# EasyEDA Pro project kuafu01_030内部老化方案_4.eprj, board PCB4
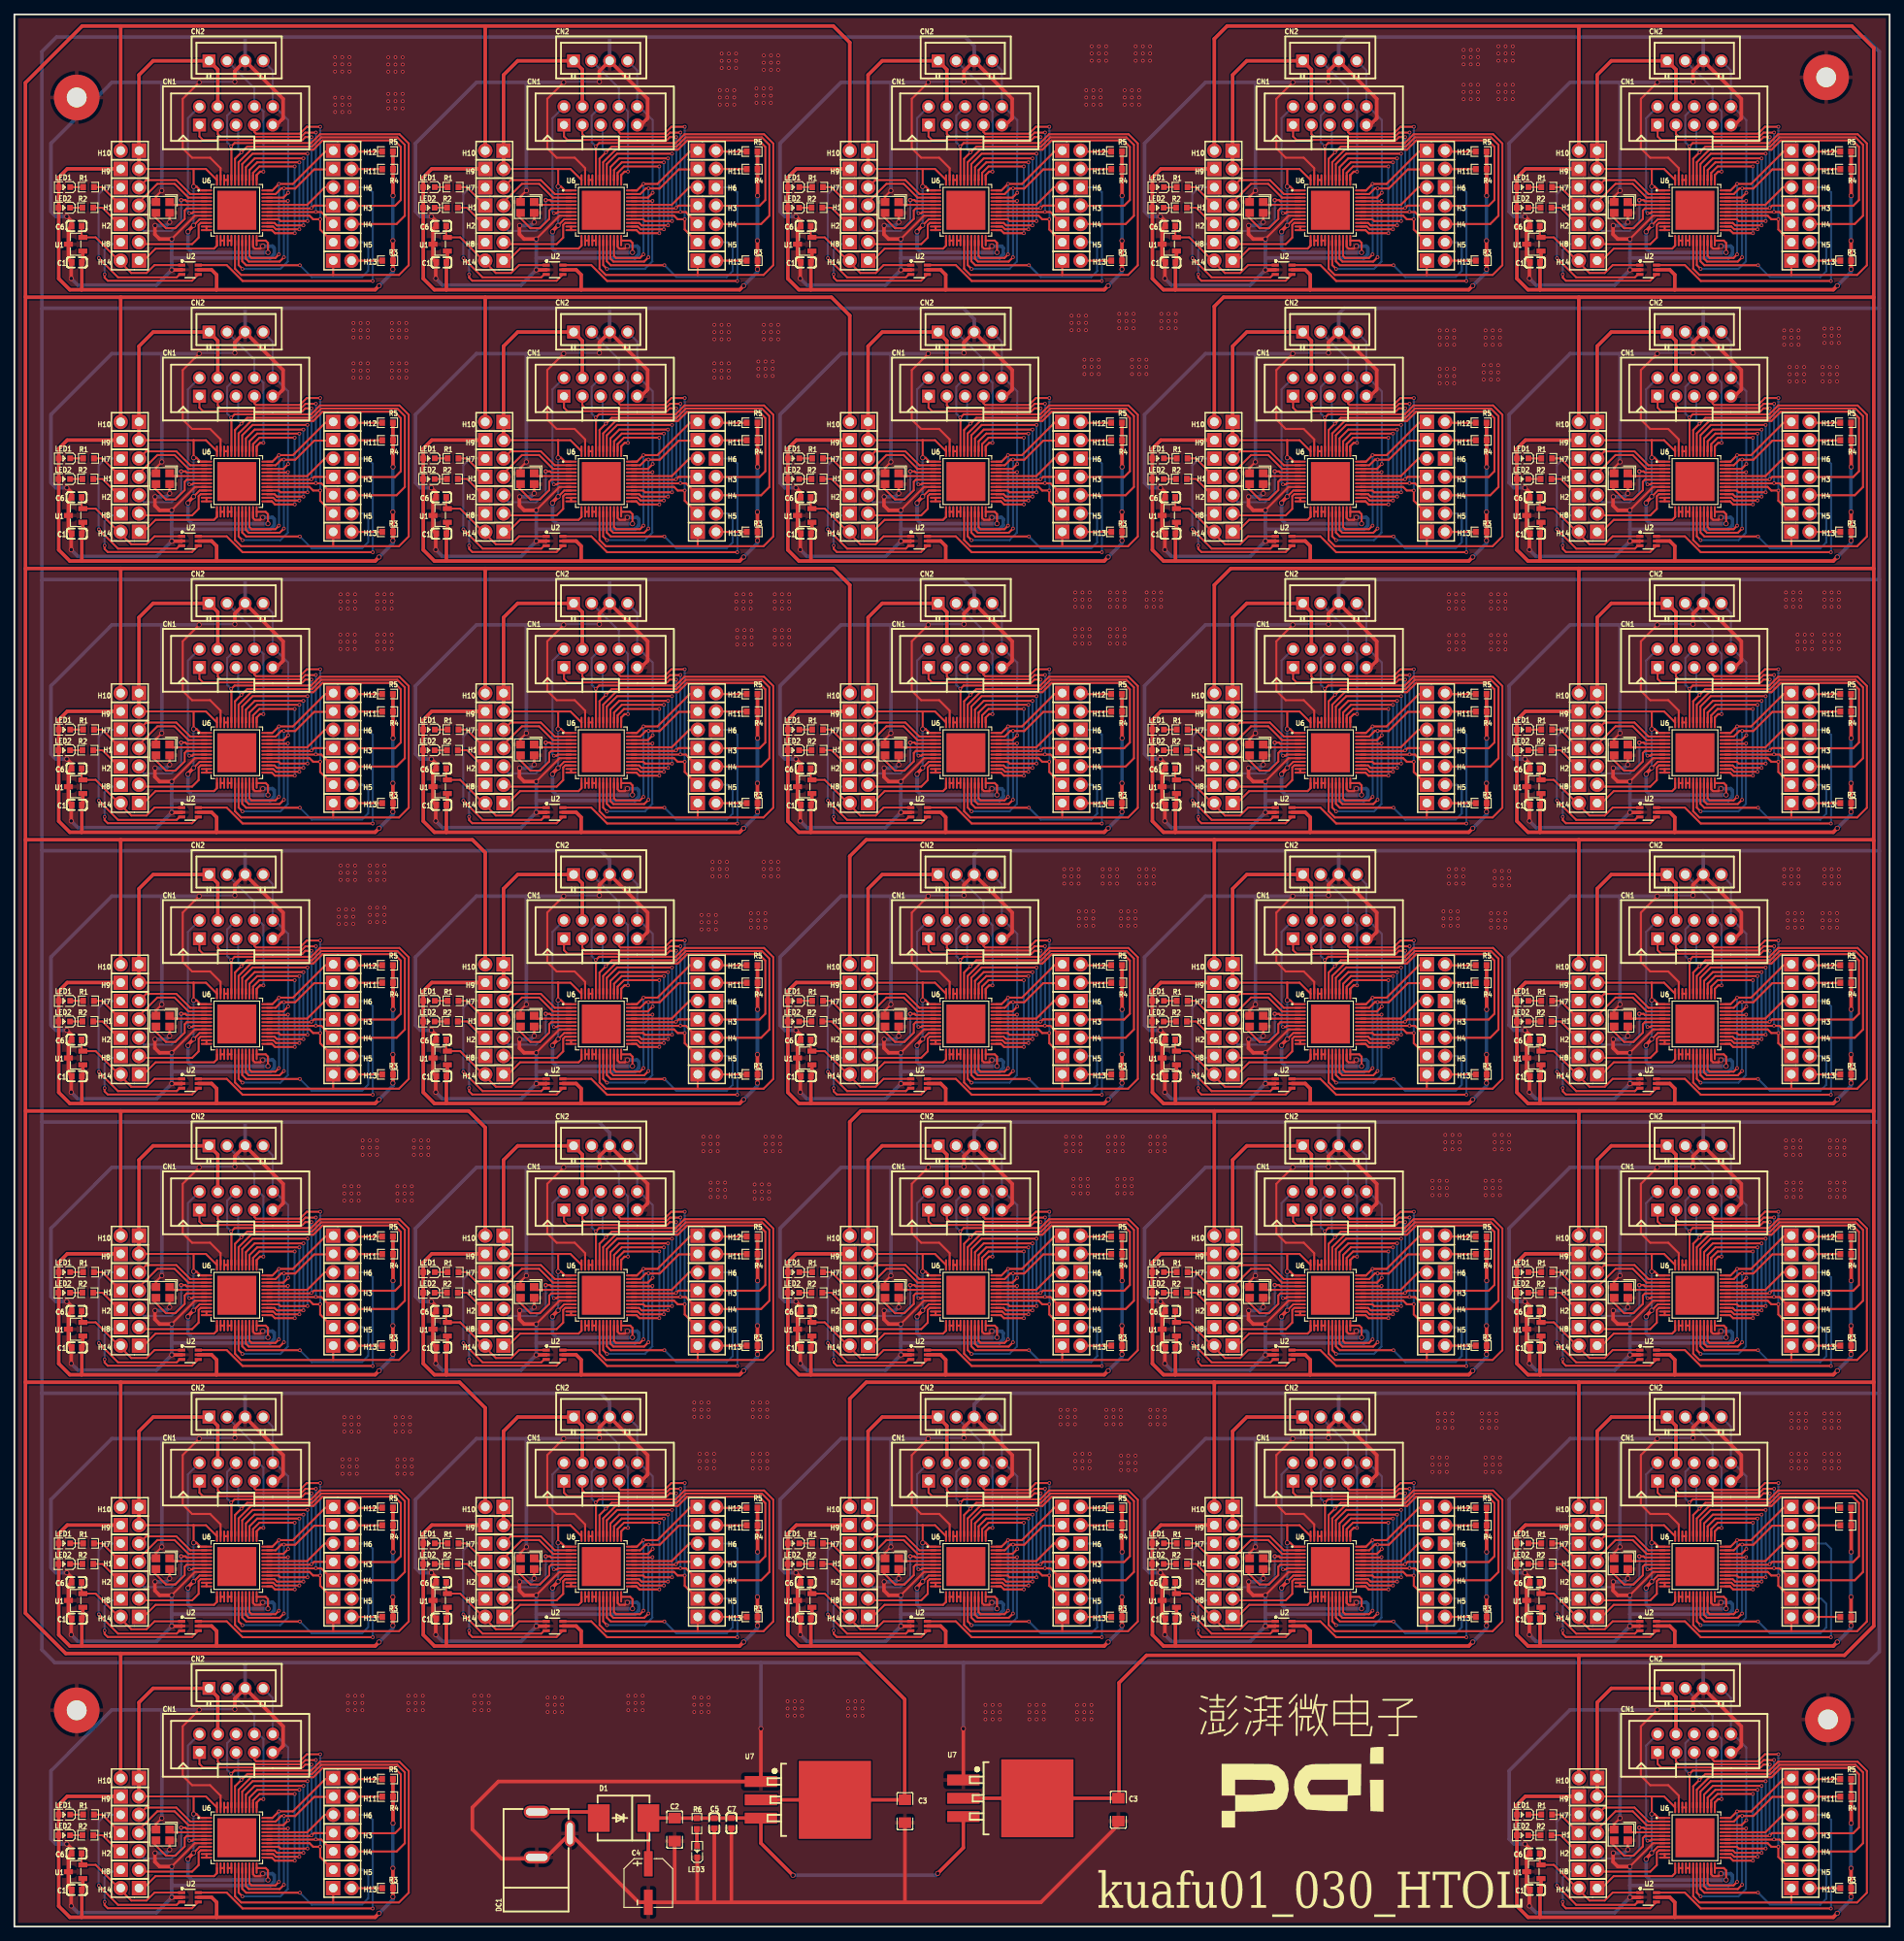
[diagram p2: board, top side]
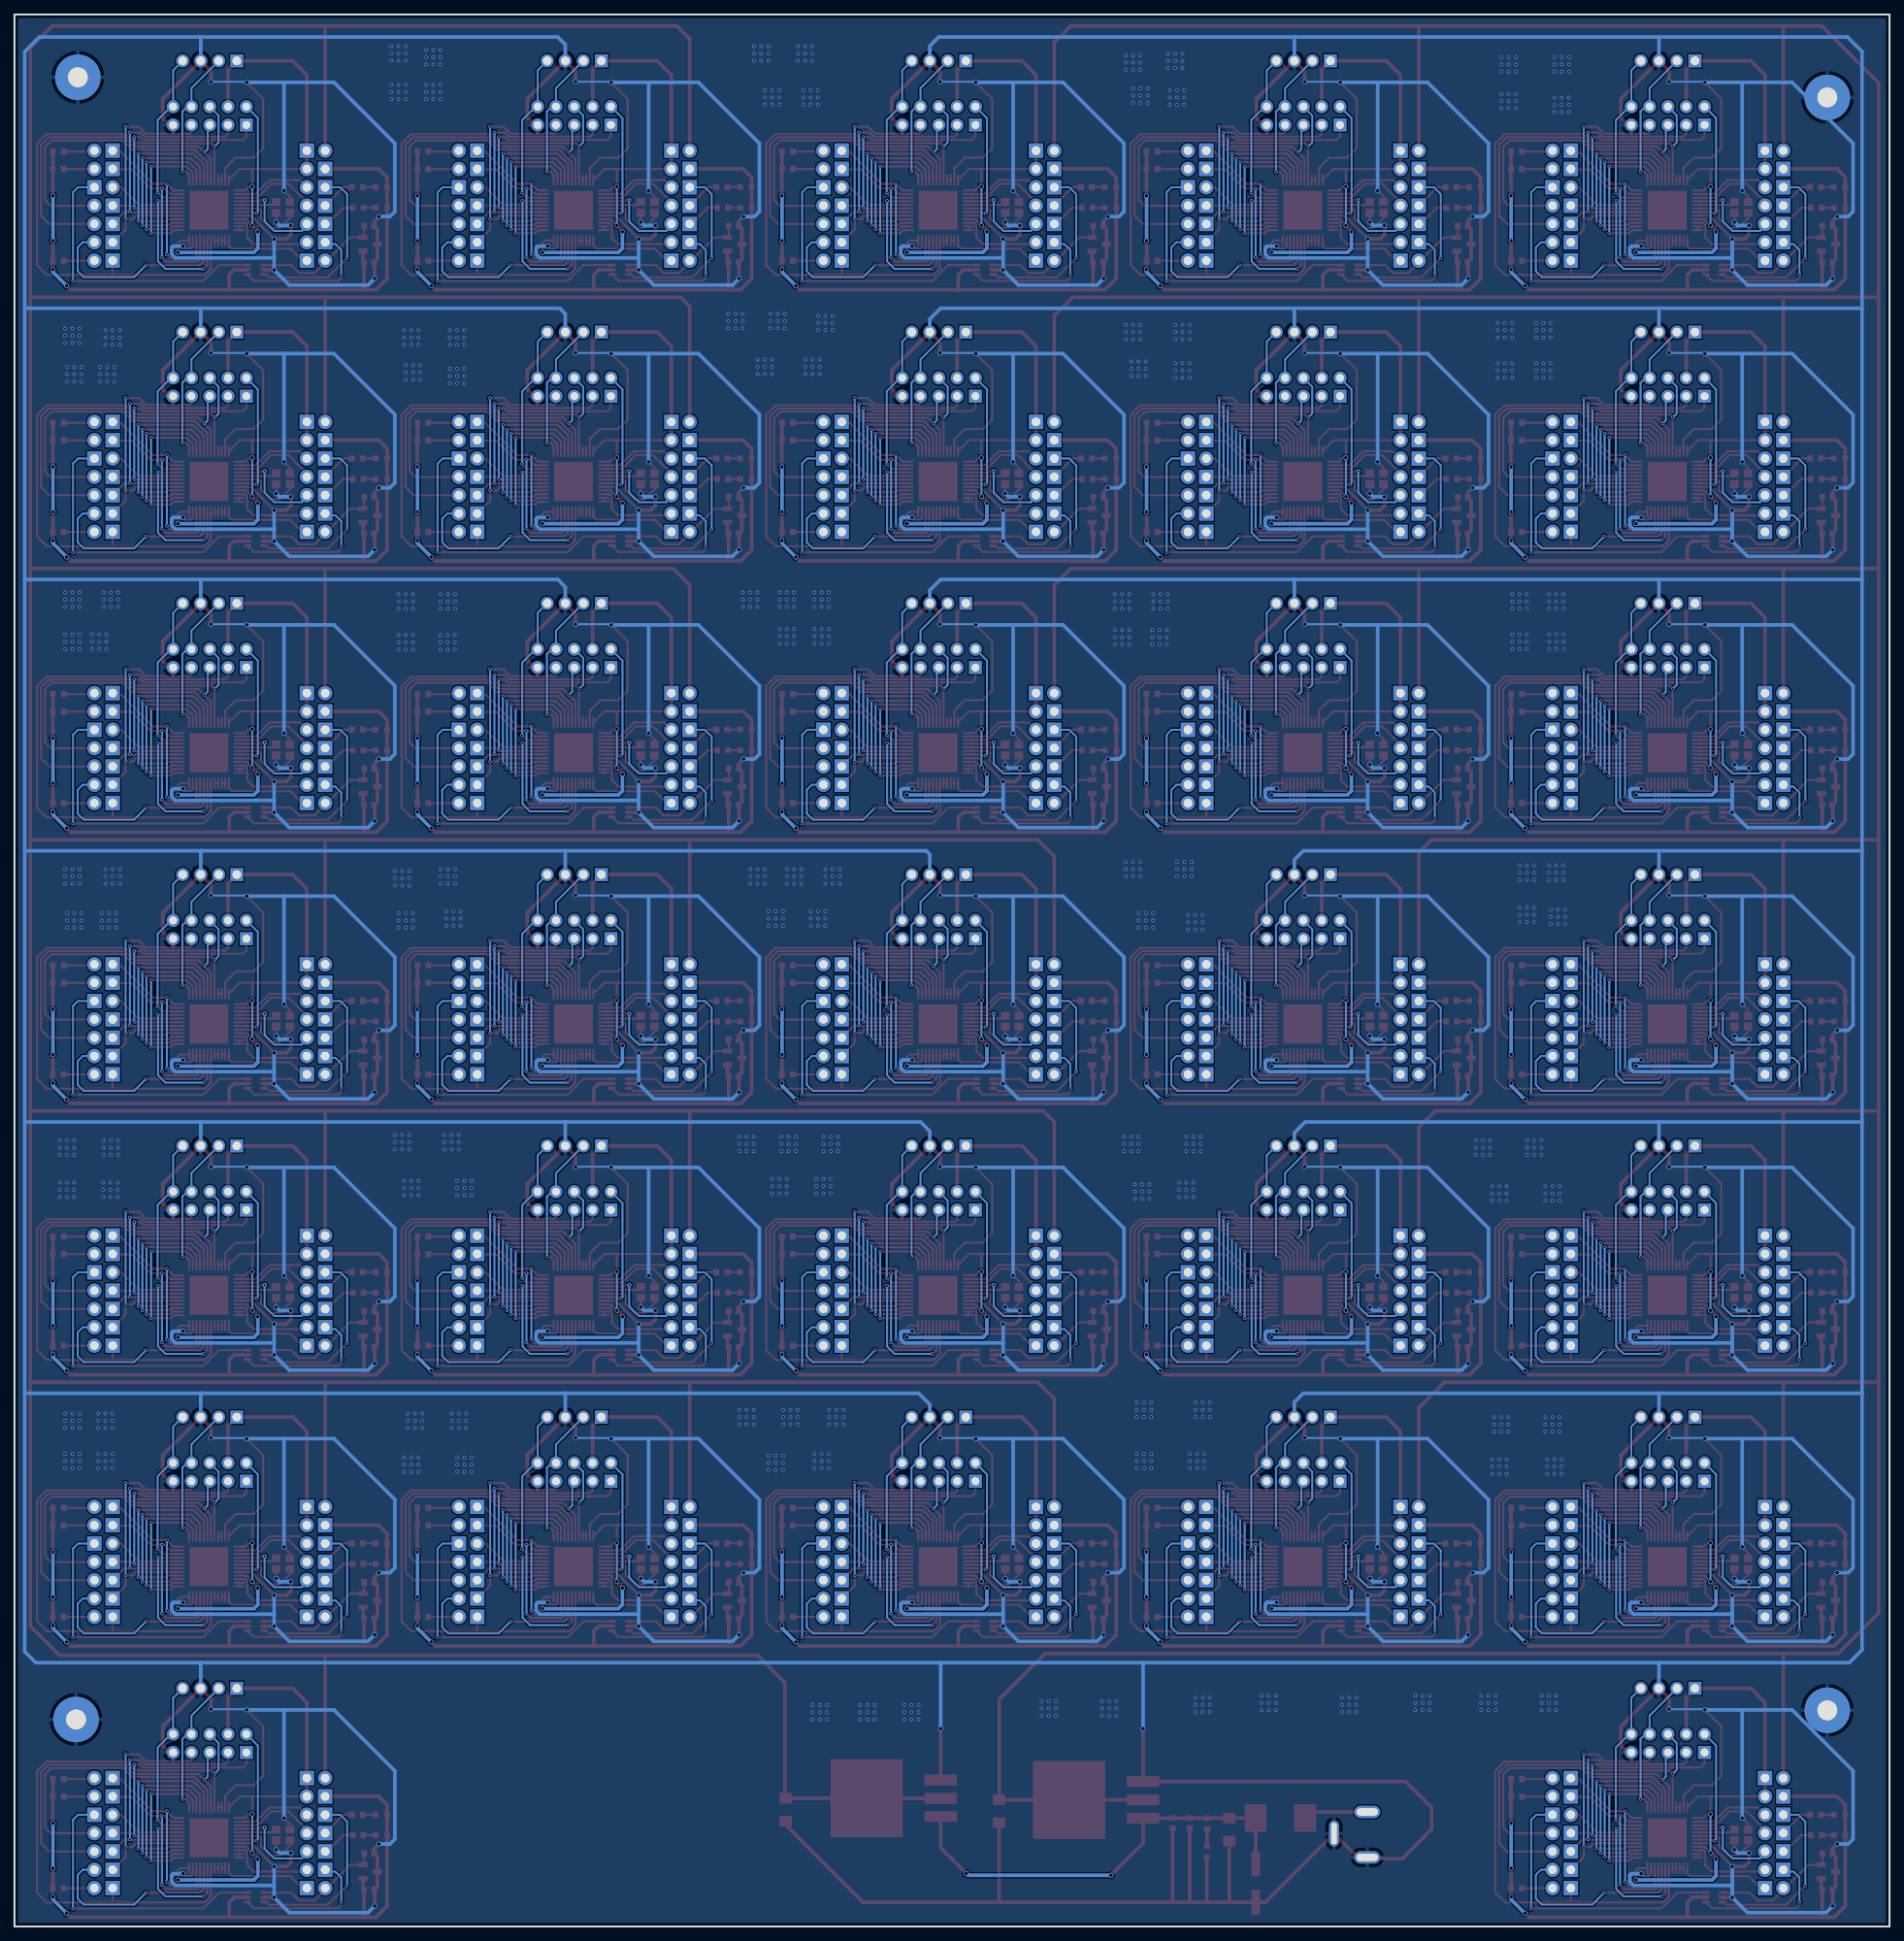
[diagram p3: board, bottom side, seen from below]

Outline 260 x 265 mm; copper layers: Top Layer, Bottom Layer. Coordinates in mm from the lower left corner of the outline.
Outline path: rectangle 0,265 260,0
Stack: Top Layer 0.035mm / Dielectric1 1.51mm FR4 er 4.5 / Bottom Layer 0.035mm

## Design rules (mm)
template: 用户自定义配置
spacing safeClearance (default): track to track 0.152, other pairs 0.152 to 0.3
track width trackWidth (default): min 0.127, default 0.254, max 2.54
differential pair differentialPair (default): width min 0.127, default 0.254, max 2.54; gap min 0.152, default 0.152
via viaSize (default): diameter min 0.5, default 0.61, max 10; hole min 0.3, default 0.305, max 6

## Placement (name value [footprint] x y rotation side)
C1  470nF  [C0603]  160.28 117.86 180 top
C1#2  -  [C0603]  59.19 230.63 180 top
C1#3  -  [C0603]  109.74 117.86 180 top
C1#4  -  [C0603]  8.64 155.45 180 top
C1#5  -  [C0603]  8.64 117.86 180 top
C1#6  -  [C0603]  210.83 155.45 180 top
C1#7  -  [C0603]  59.19 117.86 180 top
C1#8  -  [C0603]  59.19 155.45 180 top
C1#9  -  [C0603]  210.83 117.86 180 top
C1#10  -  [C0603]  160.28 155.45 180 top
C1#11  -  [C0603]  109.74 155.45 180 top
C1#12  -  [C0603]  160.28 42.67 180 top
C1#13  -  [C0603]  109.74 230.63 180 top
C1#14  -  [C0603]  109.74 42.67 180 top
C1#15  -  [C0603]  8.64 80.27 180 top
C1#16  -  [C0603]  8.64 42.67 180 top
C1#17  -  [C0603]  210.83 80.27 180 top
C1#18  -  [C0603]  59.19 42.67 180 top
C1#19  -  [C0603]  59.19 80.27 180 top
C1#20  -  [C0603]  210.83 42.67 180 top
C1#21  -  [C0603]  160.28 80.27 180 top
C1#22  -  [C0603]  8.64 230.63 180 top
C1#23  -  [C0603]  109.74 80.27 180 top
C1#24  -  [C0603]  8.64 5.08 180 top
C1#25  -  [C0603]  210.83 5.08 180 top
C1#26  -  [C0603]  160.28 230.63 180 top
C1#27  -  [C0603]  210.83 230.63 180 top
C1#28  -  [C0603]  109.74 193.04 180 top
C1#29  -  [C0603]  160.28 193.04 180 top
C1#30  -  [C0603]  210.83 193.04 180 top
C1#31  -  [C0603]  8.64 193.04 180 top
C1#32  -  [C0603]  59.19 193.04 180 top
C2  10uF  [C1206]  91.55 13.44 270 top
C3  10uF  [C1206]  123.48 15.99 90 top
C3#2  -  [C1206]  153.07 16.2 90 top
C4  100uF  [CAP-SMD_BD6.3-L6.6-W6.6-LS7.6-FD-1]  87.89 6.03 270 top
C5  100nF  [C0603]  97.04 14.32 90 top
C6  100nF  [C0603]  109.71 122.9 0 top
C6#2  -  [C0603]  59.17 235.67 0 top
C6#3  -  [C0603]  8.62 122.9 0 top
C6#4  -  [C0603]  210.81 160.49 0 top
C6#5  -  [C0603]  8.62 160.49 0 top
C6#6  -  [C0603]  210.81 122.9 0 top
C6#7  -  [C0603]  59.17 122.9 0 top
C6#8  -  [C0603]  59.17 160.49 0 top
C6#9  -  [C0603]  160.26 122.9 0 top
C6#10  -  [C0603]  160.26 160.49 0 top
C6#11  -  [C0603]  109.71 160.49 0 top
C6#12  -  [C0603]  109.71 47.71 0 top
C6#13  -  [C0603]  8.62 47.71 0 top
C6#14  -  [C0603]  109.71 235.67 0 top
C6#15  -  [C0603]  210.81 85.31 0 top
C6#16  -  [C0603]  8.62 85.31 0 top
C6#17  -  [C0603]  210.81 47.71 0 top
C6#18  -  [C0603]  59.17 47.71 0 top
C6#19  -  [C0603]  59.17 85.31 0 top
C6#20  -  [C0603]  160.26 47.71 0 top
C6#21  -  [C0603]  160.26 85.31 0 top
C6#22  -  [C0603]  109.71 85.31 0 top
C6#23  -  [C0603]  8.62 235.67 0 top
C6#24  -  [C0603]  8.62 10.12 0 top
C6#25  -  [C0603]  210.81 10.12 0 top
C6#26  -  [C0603]  160.26 235.67 0 top
C6#27  -  [C0603]  210.81 235.67 0 top
C6#28  -  [C0603]  109.71 198.08 0 top
C6#29  -  [C0603]  210.81 198.08 0 top
C6#30  -  [C0603]  8.62 198.08 0 top
C6#31  -  [C0603]  59.17 198.08 0 top
C6#32  -  [C0603]  160.26 198.08 0 top
C7  100nF  [C0603]  99.42 14.34 90 top
CN1  DS254P-2X5-L0  [IDC-TH_10P-P2.54-V-R2-C5-S2.54]  232.92 138.18 0 top
CN1#2  -  [IDC-TH_10P-P2.54-V-R2-C5-S2.54]  182.37 175.77 0 top
CN1#3  -  [IDC-TH_10P-P2.54-V-R2-C5-S2.54]  30.73 175.77 0 top
CN1#4  -  [IDC-TH_10P-P2.54-V-R2-C5-S2.54]  30.73 138.18 0 top
CN1#5  -  [IDC-TH_10P-P2.54-V-R2-C5-S2.54]  81.28 138.18 0 top
CN1#6  -  [IDC-TH_10P-P2.54-V-R2-C5-S2.54]  232.92 175.77 0 top
CN1#7  -  [IDC-TH_10P-P2.54-V-R2-C5-S2.54]  131.83 175.77 0 top
CN1#8  -  [IDC-TH_10P-P2.54-V-R2-C5-S2.54]  131.83 138.18 0 top
CN1#9  -  [IDC-TH_10P-P2.54-V-R2-C5-S2.54]  81.28 175.77 0 top
CN1#10  -  [IDC-TH_10P-P2.54-V-R2-C5-S2.54]  182.37 138.18 0 top
CN1#11  -  [IDC-TH_10P-P2.54-V-R2-C5-S2.54]  131.83 250.95 0 top
CN1#12  -  [IDC-TH_10P-P2.54-V-R2-C5-S2.54]  232.92 62.99 0 top
CN1#13  -  [IDC-TH_10P-P2.54-V-R2-C5-S2.54]  182.37 100.58 0 top
CN1#14  -  [IDC-TH_10P-P2.54-V-R2-C5-S2.54]  30.73 100.58 0 top
CN1#15  -  [IDC-TH_10P-P2.54-V-R2-C5-S2.54]  30.73 62.99 0 top
CN1#16  -  [IDC-TH_10P-P2.54-V-R2-C5-S2.54]  81.28 62.99 0 top
CN1#17  -  [IDC-TH_10P-P2.54-V-R2-C5-S2.54]  232.92 100.58 0 top
CN1#18  -  [IDC-TH_10P-P2.54-V-R2-C5-S2.54]  131.83 100.58 0 top
CN1#19  -  [IDC-TH_10P-P2.54-V-R2-C5-S2.54]  131.83 62.99 0 top
CN1#20  -  [IDC-TH_10P-P2.54-V-R2-C5-S2.54]  81.28 100.58 0 top
CN1#21  -  [IDC-TH_10P-P2.54-V-R2-C5-S2.54]  182.37 62.99 0 top
CN1#22  -  [IDC-TH_10P-P2.54-V-R2-C5-S2.54]  30.73 25.4 0 top
CN1#23  -  [IDC-TH_10P-P2.54-V-R2-C5-S2.54]  232.92 25.4 0 top
CN1#24  -  [IDC-TH_10P-P2.54-V-R2-C5-S2.54]  30.73 250.95 0 top
CN1#25  -  [IDC-TH_10P-P2.54-V-R2-C5-S2.54]  182.37 250.95 0 top
CN1#26  -  [IDC-TH_10P-P2.54-V-R2-C5-S2.54]  232.92 250.95 0 top
CN1#27  -  [IDC-TH_10P-P2.54-V-R2-C5-S2.54]  30.73 213.36 0 top
CN1#28  -  [IDC-TH_10P-P2.54-V-R2-C5-S2.54]  182.37 213.36 0 top
CN1#29  -  [IDC-TH_10P-P2.54-V-R2-C5-S2.54]  232.92 213.36 0 top
CN1#30  -  [IDC-TH_10P-P2.54-V-R2-C5-S2.54]  81.28 213.36 0 top
CN1#31  -  [IDC-TH_10P-P2.54-V-R2-C5-S2.54]  131.83 213.36 0 top
CN1#32  -  [IDC-TH_10P-P2.54-V-R2-C5-S2.54]  81.28 250.95 0 top
CN2  XH-4A  [CONN-TH_4P-P2.50_XH-4A]  30.73 145.8 0 top
CN2#2  -  [CONN-TH_4P-P2.50_XH-4A]  232.92 145.8 0 top
CN2#3  -  [CONN-TH_4P-P2.50_XH-4A]  131.83 145.8 0 top
CN2#4  -  [CONN-TH_4P-P2.50_XH-4A]  182.37 183.39 0 top
CN2#5  -  [CONN-TH_4P-P2.50_XH-4A]  81.28 145.8 0 top
CN2#6  -  [CONN-TH_4P-P2.50_XH-4A]  30.73 183.39 0 top
CN2#7  -  [CONN-TH_4P-P2.50_XH-4A]  232.92 183.39 0 top
CN2#8  -  [CONN-TH_4P-P2.50_XH-4A]  131.83 183.39 0 top
CN2#9  -  [CONN-TH_4P-P2.50_XH-4A]  81.28 183.39 0 top
CN2#10  -  [CONN-TH_4P-P2.50_XH-4A]  182.37 145.8 0 top
CN2#11  -  [CONN-TH_4P-P2.50_XH-4A]  131.83 258.57 0 top
CN2#12  -  [CONN-TH_4P-P2.50_XH-4A]  30.73 70.61 0 top
CN2#13  -  [CONN-TH_4P-P2.50_XH-4A]  232.92 70.61 0 top
CN2#14  -  [CONN-TH_4P-P2.50_XH-4A]  131.83 70.61 0 top
CN2#15  -  [CONN-TH_4P-P2.50_XH-4A]  182.37 108.2 0 top
CN2#16  -  [CONN-TH_4P-P2.50_XH-4A]  81.28 70.61 0 top
CN2#17  -  [CONN-TH_4P-P2.50_XH-4A]  30.73 108.2 0 top
CN2#18  -  [CONN-TH_4P-P2.50_XH-4A]  232.92 108.2 0 top
CN2#19  -  [CONN-TH_4P-P2.50_XH-4A]  131.83 108.2 0 top
CN2#20  -  [CONN-TH_4P-P2.50_XH-4A]  81.28 108.2 0 top
CN2#21  -  [CONN-TH_4P-P2.50_XH-4A]  182.37 70.61 0 top
CN2#22  -  [CONN-TH_4P-P2.50_XH-4A]  182.37 258.57 0 top
CN2#23  -  [CONN-TH_4P-P2.50_XH-4A]  30.73 33.02 0 top
CN2#24  -  [CONN-TH_4P-P2.50_XH-4A]  232.92 33.02 0 top
CN2#25  -  [CONN-TH_4P-P2.50_XH-4A]  30.73 258.57 0 top
CN2#26  -  [CONN-TH_4P-P2.50_XH-4A]  232.92 258.57 0 top
CN2#27  -  [CONN-TH_4P-P2.50_XH-4A]  81.28 258.57 0 top
CN2#28  -  [CONN-TH_4P-P2.50_XH-4A]  30.73 220.98 0 top
CN2#29  -  [CONN-TH_4P-P2.50_XH-4A]  182.37 220.98 0 top
CN2#30  -  [CONN-TH_4P-P2.50_XH-4A]  232.92 220.98 0 top
CN2#31  -  [CONN-TH_4P-P2.50_XH-4A]  131.83 220.98 0 top
CN2#32  -  [CONN-TH_4P-P2.50_XH-4A]  81.28 220.98 0 top
D1  SS36-E3/57T  [SMC_L7.1-W6.2-LS8.1-R-RD]  84.46 15.04 180 top
DC1  HX DC005 QT  [DC-IN-TH_HANXIA_HX-DC005-QT]  74.72 12.74 90 top
H1  PZ254V-11-02P  [HDR-TH_2P-P2.54-V-M]  66.55 238.51 0 top
H1#2  -  [HDR-TH_2P-P2.54-V-M]  218.19 125.73 0 top
H1#3  -  [HDR-TH_2P-P2.54-V-M]  66.55 125.73 0 top
H1#4  -  [HDR-TH_2P-P2.54-V-M]  16 125.73 0 top
H1#5  -  [HDR-TH_2P-P2.54-V-M]  117.09 125.73 0 top
H1#6  -  [HDR-TH_2P-P2.54-V-M]  218.19 163.32 0 top
H1#7  -  [HDR-TH_2P-P2.54-V-M]  117.09 163.32 0 top
H1#8  -  [HDR-TH_2P-P2.54-V-M]  16 163.32 0 top
H1#9  -  [HDR-TH_2P-P2.54-V-M]  66.55 163.32 0 top
H1#10  -  [HDR-TH_2P-P2.54-V-M]  167.64 125.73 0 top
H1#11  -  [HDR-TH_2P-P2.54-V-M]  167.64 163.32 0 top
H1#12  -  [HDR-TH_2P-P2.54-V-M]  218.19 50.55 0 top
H1#13  -  [HDR-TH_2P-P2.54-V-M]  66.55 50.55 0 top
H1#14  -  [HDR-TH_2P-P2.54-V-M]  16 50.55 0 top
H1#15  -  [HDR-TH_2P-P2.54-V-M]  117.09 238.51 0 top
H1#16  -  [HDR-TH_2P-P2.54-V-M]  117.09 50.55 0 top
H1#17  -  [HDR-TH_2P-P2.54-V-M]  218.19 88.14 0 top
H1#18  -  [HDR-TH_2P-P2.54-V-M]  117.09 88.14 0 top
H1#19  -  [HDR-TH_2P-P2.54-V-M]  16 88.14 0 top
H1#20  -  [HDR-TH_2P-P2.54-V-M]  66.55 88.14 0 top
H1#21  -  [HDR-TH_2P-P2.54-V-M]  167.64 50.55 0 top
H1#22  -  [HDR-TH_2P-P2.54-V-M]  167.64 88.14 0 top
H1#23  -  [HDR-TH_2P-P2.54-V-M]  16 12.95 0 top
H1#24  -  [HDR-TH_2P-P2.54-V-M]  16 238.51 0 top
H1#25  -  [HDR-TH_2P-P2.54-V-M]  218.19 12.95 0 top
H1#26  -  [HDR-TH_2P-P2.54-V-M]  167.64 238.51 0 top
H1#27  -  [HDR-TH_2P-P2.54-V-M]  218.19 238.51 0 top
H1#28  -  [HDR-TH_2P-P2.54-V-M]  66.55 200.91 0 top
H1#29  -  [HDR-TH_2P-P2.54-V-M]  117.09 200.91 0 top
H1#30  -  [HDR-TH_2P-P2.54-V-M]  218.19 200.91 0 top
H1#31  -  [HDR-TH_2P-P2.54-V-M]  16 200.91 0 top
H1#32  -  [HDR-TH_2P-P2.54-V-M]  167.64 200.91 0 top
H2  PZ254V-11-02P  [HDR-TH_2P-P2.54-V-M]  218.19 123.19 0 top
H2#2  -  [HDR-TH_2P-P2.54-V-M]  66.55 235.97 0 top
H2#3  -  [HDR-TH_2P-P2.54-V-M]  117.09 123.19 0 top
H2#4  -  [HDR-TH_2P-P2.54-V-M]  218.19 160.78 0 top
H2#5  -  [HDR-TH_2P-P2.54-V-M]  117.09 160.78 0 top
H2#6  -  [HDR-TH_2P-P2.54-V-M]  66.55 123.19 0 top
H2#7  -  [HDR-TH_2P-P2.54-V-M]  16 160.78 0 top
H2#8  -  [HDR-TH_2P-P2.54-V-M]  16 123.19 0 top
H2#9  -  [HDR-TH_2P-P2.54-V-M]  167.64 123.19 0 top
H2#10  -  [HDR-TH_2P-P2.54-V-M]  167.64 160.78 0 top
H2#11  -  [HDR-TH_2P-P2.54-V-M]  66.55 160.78 0 top
H2#12  -  [HDR-TH_2P-P2.54-V-M]  218.19 48.01 0 top
H2#13  -  [HDR-TH_2P-P2.54-V-M]  117.09 235.97 0 top
H2#14  -  [HDR-TH_2P-P2.54-V-M]  117.09 48.01 0 top
H2#15  -  [HDR-TH_2P-P2.54-V-M]  218.19 85.6 0 top
H2#16  -  [HDR-TH_2P-P2.54-V-M]  117.09 85.6 0 top
H2#17  -  [HDR-TH_2P-P2.54-V-M]  66.55 48.01 0 top
H2#18  -  [HDR-TH_2P-P2.54-V-M]  16 85.6 0 top
H2#19  -  [HDR-TH_2P-P2.54-V-M]  16 48.01 0 top
H2#20  -  [HDR-TH_2P-P2.54-V-M]  167.64 48.01 0 top
H2#21  -  [HDR-TH_2P-P2.54-V-M]  167.64 85.6 0 top
H2#22  -  [HDR-TH_2P-P2.54-V-M]  66.55 85.6 0 top
H2#23  -  [HDR-TH_2P-P2.54-V-M]  16 10.41 0 top
H2#24  -  [HDR-TH_2P-P2.54-V-M]  16 235.97 0 top
H2#25  -  [HDR-TH_2P-P2.54-V-M]  218.19 10.41 0 top
H2#26  -  [HDR-TH_2P-P2.54-V-M]  167.64 235.97 0 top
H2#27  -  [HDR-TH_2P-P2.54-V-M]  218.19 235.97 0 top
H2#28  -  [HDR-TH_2P-P2.54-V-M]  117.09 198.37 0 top
H2#29  -  [HDR-TH_2P-P2.54-V-M]  218.19 198.37 0 top
H2#30  -  [HDR-TH_2P-P2.54-V-M]  16 198.37 0 top
H2#31  -  [HDR-TH_2P-P2.54-V-M]  66.55 198.37 0 top
H2#32  -  [HDR-TH_2P-P2.54-V-M]  167.64 198.37 0 top
H3  PZ254V-11-02P  [HDR-TH_2P-P2.54-V-M]  96.01 238.51 0 top
H3#2  -  [HDR-TH_2P-P2.54-V-M]  96.01 125.73 0 top
H3#3  -  [HDR-TH_2P-P2.54-V-M]  45.47 125.73 0 top
H3#4  -  [HDR-TH_2P-P2.54-V-M]  247.65 163.32 0 top
H3#5  -  [HDR-TH_2P-P2.54-V-M]  146.56 125.73 0 top
H3#6  -  [HDR-TH_2P-P2.54-V-M]  45.47 163.32 0 top
H3#7  -  [HDR-TH_2P-P2.54-V-M]  247.65 125.73 0 top
H3#8  -  [HDR-TH_2P-P2.54-V-M]  197.1 125.73 0 top
H3#9  -  [HDR-TH_2P-P2.54-V-M]  146.56 163.32 0 top
H3#10  -  [HDR-TH_2P-P2.54-V-M]  96.01 163.32 0 top
H3#11  -  [HDR-TH_2P-P2.54-V-M]  197.1 163.32 0 top
H3#12  -  [HDR-TH_2P-P2.54-V-M]  146.56 238.51 0 top
H3#13  -  [HDR-TH_2P-P2.54-V-M]  96.01 50.55 0 top
H3#14  -  [HDR-TH_2P-P2.54-V-M]  45.47 50.55 0 top
H3#15  -  [HDR-TH_2P-P2.54-V-M]  247.65 88.14 0 top
H3#16  -  [HDR-TH_2P-P2.54-V-M]  146.56 50.55 0 top
H3#17  -  [HDR-TH_2P-P2.54-V-M]  45.47 88.14 0 top
H3#18  -  [HDR-TH_2P-P2.54-V-M]  247.65 50.55 0 top
H3#19  -  [HDR-TH_2P-P2.54-V-M]  197.1 50.55 0 top
H3#20  -  [HDR-TH_2P-P2.54-V-M]  146.56 88.14 0 top
H3#21  -  [HDR-TH_2P-P2.54-V-M]  96.01 88.14 0 top
H3#22  -  [HDR-TH_2P-P2.54-V-M]  197.1 88.14 0 top
H3#23  -  [HDR-TH_2P-P2.54-V-M]  45.47 12.95 0 top
H3#24  -  [HDR-TH_2P-P2.54-V-M]  247.65 12.95 0 top
H3#25  -  [HDR-TH_2P-P2.54-V-M]  45.47 238.51 0 top
H3#26  -  [HDR-TH_2P-P2.54-V-M]  197.1 238.51 0 top
H3#27  -  [HDR-TH_2P-P2.54-V-M]  247.65 238.51 0 top
H3#28  -  [HDR-TH_2P-P2.54-V-M]  247.65 200.91 0 top
H3#29  -  [HDR-TH_2P-P2.54-V-M]  45.47 200.91 0 top
H3#30  -  [HDR-TH_2P-P2.54-V-M]  96.01 200.91 0 top
H3#31  -  [HDR-TH_2P-P2.54-V-M]  146.56 200.91 0 top
H3#32  -  [HDR-TH_2P-P2.54-V-M]  197.1 200.91 0 top
H4  PZ254V-11-02P  [HDR-TH_2P-P2.54-V-M]  96.01 123.19 0 top
H4#2  -  [HDR-TH_2P-P2.54-V-M]  45.47 160.78 0 top
H4#3  -  [HDR-TH_2P-P2.54-V-M]  45.47 123.19 0 top
H4#4  -  [HDR-TH_2P-P2.54-V-M]  146.56 123.19 0 top
H4#5  -  [HDR-TH_2P-P2.54-V-M]  247.65 123.19 0 top
H4#6  -  [HDR-TH_2P-P2.54-V-M]  197.1 123.19 0 top
H4#7  -  [HDR-TH_2P-P2.54-V-M]  247.65 160.78 0 top
H4#8  -  [HDR-TH_2P-P2.54-V-M]  96.01 160.78 0 top
H4#9  -  [HDR-TH_2P-P2.54-V-M]  146.56 160.78 0 top
H4#10  -  [HDR-TH_2P-P2.54-V-M]  146.56 235.97 0 top
H4#11  -  [HDR-TH_2P-P2.54-V-M]  197.1 160.78 0 top
H4#12  -  [HDR-TH_2P-P2.54-V-M]  96.01 48.01 0 top
H4#13  -  [HDR-TH_2P-P2.54-V-M]  45.47 85.6 0 top
H4#14  -  [HDR-TH_2P-P2.54-V-M]  45.47 48.01 0 top
H4#15  -  [HDR-TH_2P-P2.54-V-M]  146.56 48.01 0 top
H4#16  -  [HDR-TH_2P-P2.54-V-M]  247.65 48.01 0 top
H4#17  -  [HDR-TH_2P-P2.54-V-M]  197.1 48.01 0 top
H4#18  -  [HDR-TH_2P-P2.54-V-M]  247.65 85.6 0 top
H4#19  -  [HDR-TH_2P-P2.54-V-M]  96.01 85.6 0 top
H4#20  -  [HDR-TH_2P-P2.54-V-M]  146.56 85.6 0 top
H4#21  -  [HDR-TH_2P-P2.54-V-M]  197.1 85.6 0 top
H4#22  -  [HDR-TH_2P-P2.54-V-M]  45.47 10.41 0 top
H4#23  -  [HDR-TH_2P-P2.54-V-M]  247.65 10.41 0 top
H4#24  -  [HDR-TH_2P-P2.54-V-M]  197.1 235.97 0 top
H4#25  -  [HDR-TH_2P-P2.54-V-M]  45.47 235.97 0 top
H4#26  -  [HDR-TH_2P-P2.54-V-M]  247.65 235.97 0 top
H4#27  -  [HDR-TH_2P-P2.54-V-M]  247.65 198.37 0 top
H4#28  -  [HDR-TH_2P-P2.54-V-M]  45.47 198.37 0 top
H4#29  -  [HDR-TH_2P-P2.54-V-M]  96.01 198.37 0 top
H4#30  -  [HDR-TH_2P-P2.54-V-M]  146.56 198.37 0 top
H4#31  -  [HDR-TH_2P-P2.54-V-M]  197.1 198.37 0 top
H4#32  -  [HDR-TH_2P-P2.54-V-M]  96.01 235.97 0 top
H5  PZ254V-11-02P  [HDR-TH_2P-P2.54-V-M]  96.01 233.43 0 top
H5#2  -  [HDR-TH_2P-P2.54-V-M]  146.56 120.65 0 top
H5#3  -  [HDR-TH_2P-P2.54-V-M]  96.01 120.65 0 top
H5#4  -  [HDR-TH_2P-P2.54-V-M]  45.47 158.24 0 top
H5#5  -  [HDR-TH_2P-P2.54-V-M]  45.47 120.65 0 top
H5#6  -  [HDR-TH_2P-P2.54-V-M]  247.65 120.65 0 top
H5#7  -  [HDR-TH_2P-P2.54-V-M]  197.1 120.65 0 top
H5#8  -  [HDR-TH_2P-P2.54-V-M]  247.65 158.24 0 top
H5#9  -  [HDR-TH_2P-P2.54-V-M]  96.01 158.24 0 top
H5#10  -  [HDR-TH_2P-P2.54-V-M]  146.56 158.24 0 top
H5#11  -  [HDR-TH_2P-P2.54-V-M]  146.56 233.43 0 top
H5#12  -  [HDR-TH_2P-P2.54-V-M]  197.1 158.24 0 top
H5#13  -  [HDR-TH_2P-P2.54-V-M]  146.56 45.47 0 top
H5#14  -  [HDR-TH_2P-P2.54-V-M]  96.01 45.47 0 top
H5#15  -  [HDR-TH_2P-P2.54-V-M]  45.47 83.06 0 top
H5#16  -  [HDR-TH_2P-P2.54-V-M]  45.47 45.47 0 top
H5#17  -  [HDR-TH_2P-P2.54-V-M]  247.65 45.47 0 top
H5#18  -  [HDR-TH_2P-P2.54-V-M]  197.1 45.47 0 top
H5#19  -  [HDR-TH_2P-P2.54-V-M]  247.65 83.06 0 top
H5#20  -  [HDR-TH_2P-P2.54-V-M]  96.01 83.06 0 top
H5#21  -  [HDR-TH_2P-P2.54-V-M]  146.56 83.06 0 top
H5#22  -  [HDR-TH_2P-P2.54-V-M]  197.1 83.06 0 top
H5#23  -  [HDR-TH_2P-P2.54-V-M]  45.47 7.87 0 top
H5#24  -  [HDR-TH_2P-P2.54-V-M]  247.65 7.87 0 top
H5#25  -  [HDR-TH_2P-P2.54-V-M]  197.1 233.43 0 top
H5#26  -  [HDR-TH_2P-P2.54-V-M]  45.47 233.43 0 top
H5#27  -  [HDR-TH_2P-P2.54-V-M]  247.65 233.43 0 top
H5#28  -  [HDR-TH_2P-P2.54-V-M]  247.65 195.83 0 top
H5#29  -  [HDR-TH_2P-P2.54-V-M]  45.47 195.83 0 top
H5#30  -  [HDR-TH_2P-P2.54-V-M]  96.01 195.83 0 top
H5#31  -  [HDR-TH_2P-P2.54-V-M]  146.56 195.83 0 top
H5#32  -  [HDR-TH_2P-P2.54-V-M]  197.1 195.83 0 top
H6  PZ254V-11-02P  [HDR-TH_2P-P2.54-V-M]  96.01 241.05 180 top
H6#2  -  [HDR-TH_2P-P2.54-V-M]  96.01 128.27 180 top
H6#3  -  [HDR-TH_2P-P2.54-V-M]  45.47 165.86 180 top
H6#4  -  [HDR-TH_2P-P2.54-V-M]  45.47 128.27 180 top
H6#5  -  [HDR-TH_2P-P2.54-V-M]  247.65 165.86 180 top
H6#6  -  [HDR-TH_2P-P2.54-V-M]  146.56 128.27 180 top
H6#7  -  [HDR-TH_2P-P2.54-V-M]  247.65 128.27 180 top
H6#8  -  [HDR-TH_2P-P2.54-V-M]  197.1 128.27 180 top
H6#9  -  [HDR-TH_2P-P2.54-V-M]  146.56 165.86 180 top
H6#10  -  [HDR-TH_2P-P2.54-V-M]  197.1 165.86 180 top
H6#11  -  [HDR-TH_2P-P2.54-V-M]  96.01 165.86 180 top
H6#12  -  [HDR-TH_2P-P2.54-V-M]  146.56 241.05 180 top
H6#13  -  [HDR-TH_2P-P2.54-V-M]  96.01 53.09 180 top
H6#14  -  [HDR-TH_2P-P2.54-V-M]  45.47 90.68 180 top
H6#15  -  [HDR-TH_2P-P2.54-V-M]  45.47 53.09 180 top
H6#16  -  [HDR-TH_2P-P2.54-V-M]  247.65 90.68 180 top
H6#17  -  [HDR-TH_2P-P2.54-V-M]  146.56 53.09 180 top
H6#18  -  [HDR-TH_2P-P2.54-V-M]  247.65 53.09 180 top
H6#19  -  [HDR-TH_2P-P2.54-V-M]  197.1 53.09 180 top
H6#20  -  [HDR-TH_2P-P2.54-V-M]  146.56 90.68 180 top
H6#21  -  [HDR-TH_2P-P2.54-V-M]  197.1 90.68 180 top
H6#22  -  [HDR-TH_2P-P2.54-V-M]  96.01 90.68 180 top
H6#23  -  [HDR-TH_2P-P2.54-V-M]  45.47 15.49 180 top
H6#24  -  [HDR-TH_2P-P2.54-V-M]  247.65 15.49 180 top
H6#25  -  [HDR-TH_2P-P2.54-V-M]  45.47 241.05 180 top
H6#26  -  [HDR-TH_2P-P2.54-V-M]  197.1 241.05 180 top
H6#27  -  [HDR-TH_2P-P2.54-V-M]  247.65 241.05 180 top
H6#28  -  [HDR-TH_2P-P2.54-V-M]  247.65 203.45 180 top
H6#29  -  [HDR-TH_2P-P2.54-V-M]  45.47 203.45 180 top
H6#30  -  [HDR-TH_2P-P2.54-V-M]  146.56 203.45 180 top
H6#31  -  [HDR-TH_2P-P2.54-V-M]  197.1 203.45 180 top
H6#32  -  [HDR-TH_2P-P2.54-V-M]  96.01 203.45 180 top
H7  PZ254V-11-02P  [HDR-TH_2P-P2.54-V-M]  66.55 241.05 0 top
H7#2  -  [HDR-TH_2P-P2.54-V-M]  218.19 128.27 0 top
H7#3  -  [HDR-TH_2P-P2.54-V-M]  16 128.27 0 top
H7#4  -  [HDR-TH_2P-P2.54-V-M]  117.09 128.27 0 top
H7#5  -  [HDR-TH_2P-P2.54-V-M]  117.09 165.86 0 top
H7#6  -  [HDR-TH_2P-P2.54-V-M]  167.64 128.27 0 top
H7#7  -  [HDR-TH_2P-P2.54-V-M]  218.19 165.86 0 top
H7#8  -  [HDR-TH_2P-P2.54-V-M]  66.55 128.27 0 top
H7#9  -  [HDR-TH_2P-P2.54-V-M]  16 165.86 0 top
H7#10  -  [HDR-TH_2P-P2.54-V-M]  66.55 165.86 0 top
H7#11  -  [HDR-TH_2P-P2.54-V-M]  167.64 165.86 0 top
H7#12  -  [HDR-TH_2P-P2.54-V-M]  218.19 53.09 0 top
H7#13  -  [HDR-TH_2P-P2.54-V-M]  16 53.09 0 top
H7#14  -  [HDR-TH_2P-P2.54-V-M]  117.09 241.05 0 top
H7#15  -  [HDR-TH_2P-P2.54-V-M]  117.09 53.09 0 top
H7#16  -  [HDR-TH_2P-P2.54-V-M]  117.09 90.68 0 top
H7#17  -  [HDR-TH_2P-P2.54-V-M]  167.64 53.09 0 top
H7#18  -  [HDR-TH_2P-P2.54-V-M]  218.19 90.68 0 top
H7#19  -  [HDR-TH_2P-P2.54-V-M]  66.55 53.09 0 top